# EasyEDA Pro project BLDCv5.eprj, schematic Schematic1
Create Date: 2024-09-21; Page Name: P1; Project Name: BLDCv5; Schematic Name: Schematic1; Update Date: 2024-09-23; Company: EasyEDA.com; Drawn: EasyEDA; Page Size: A4; Part Number: JLCPCB-002; Reviewed: EasyEDA; Version: V0.1
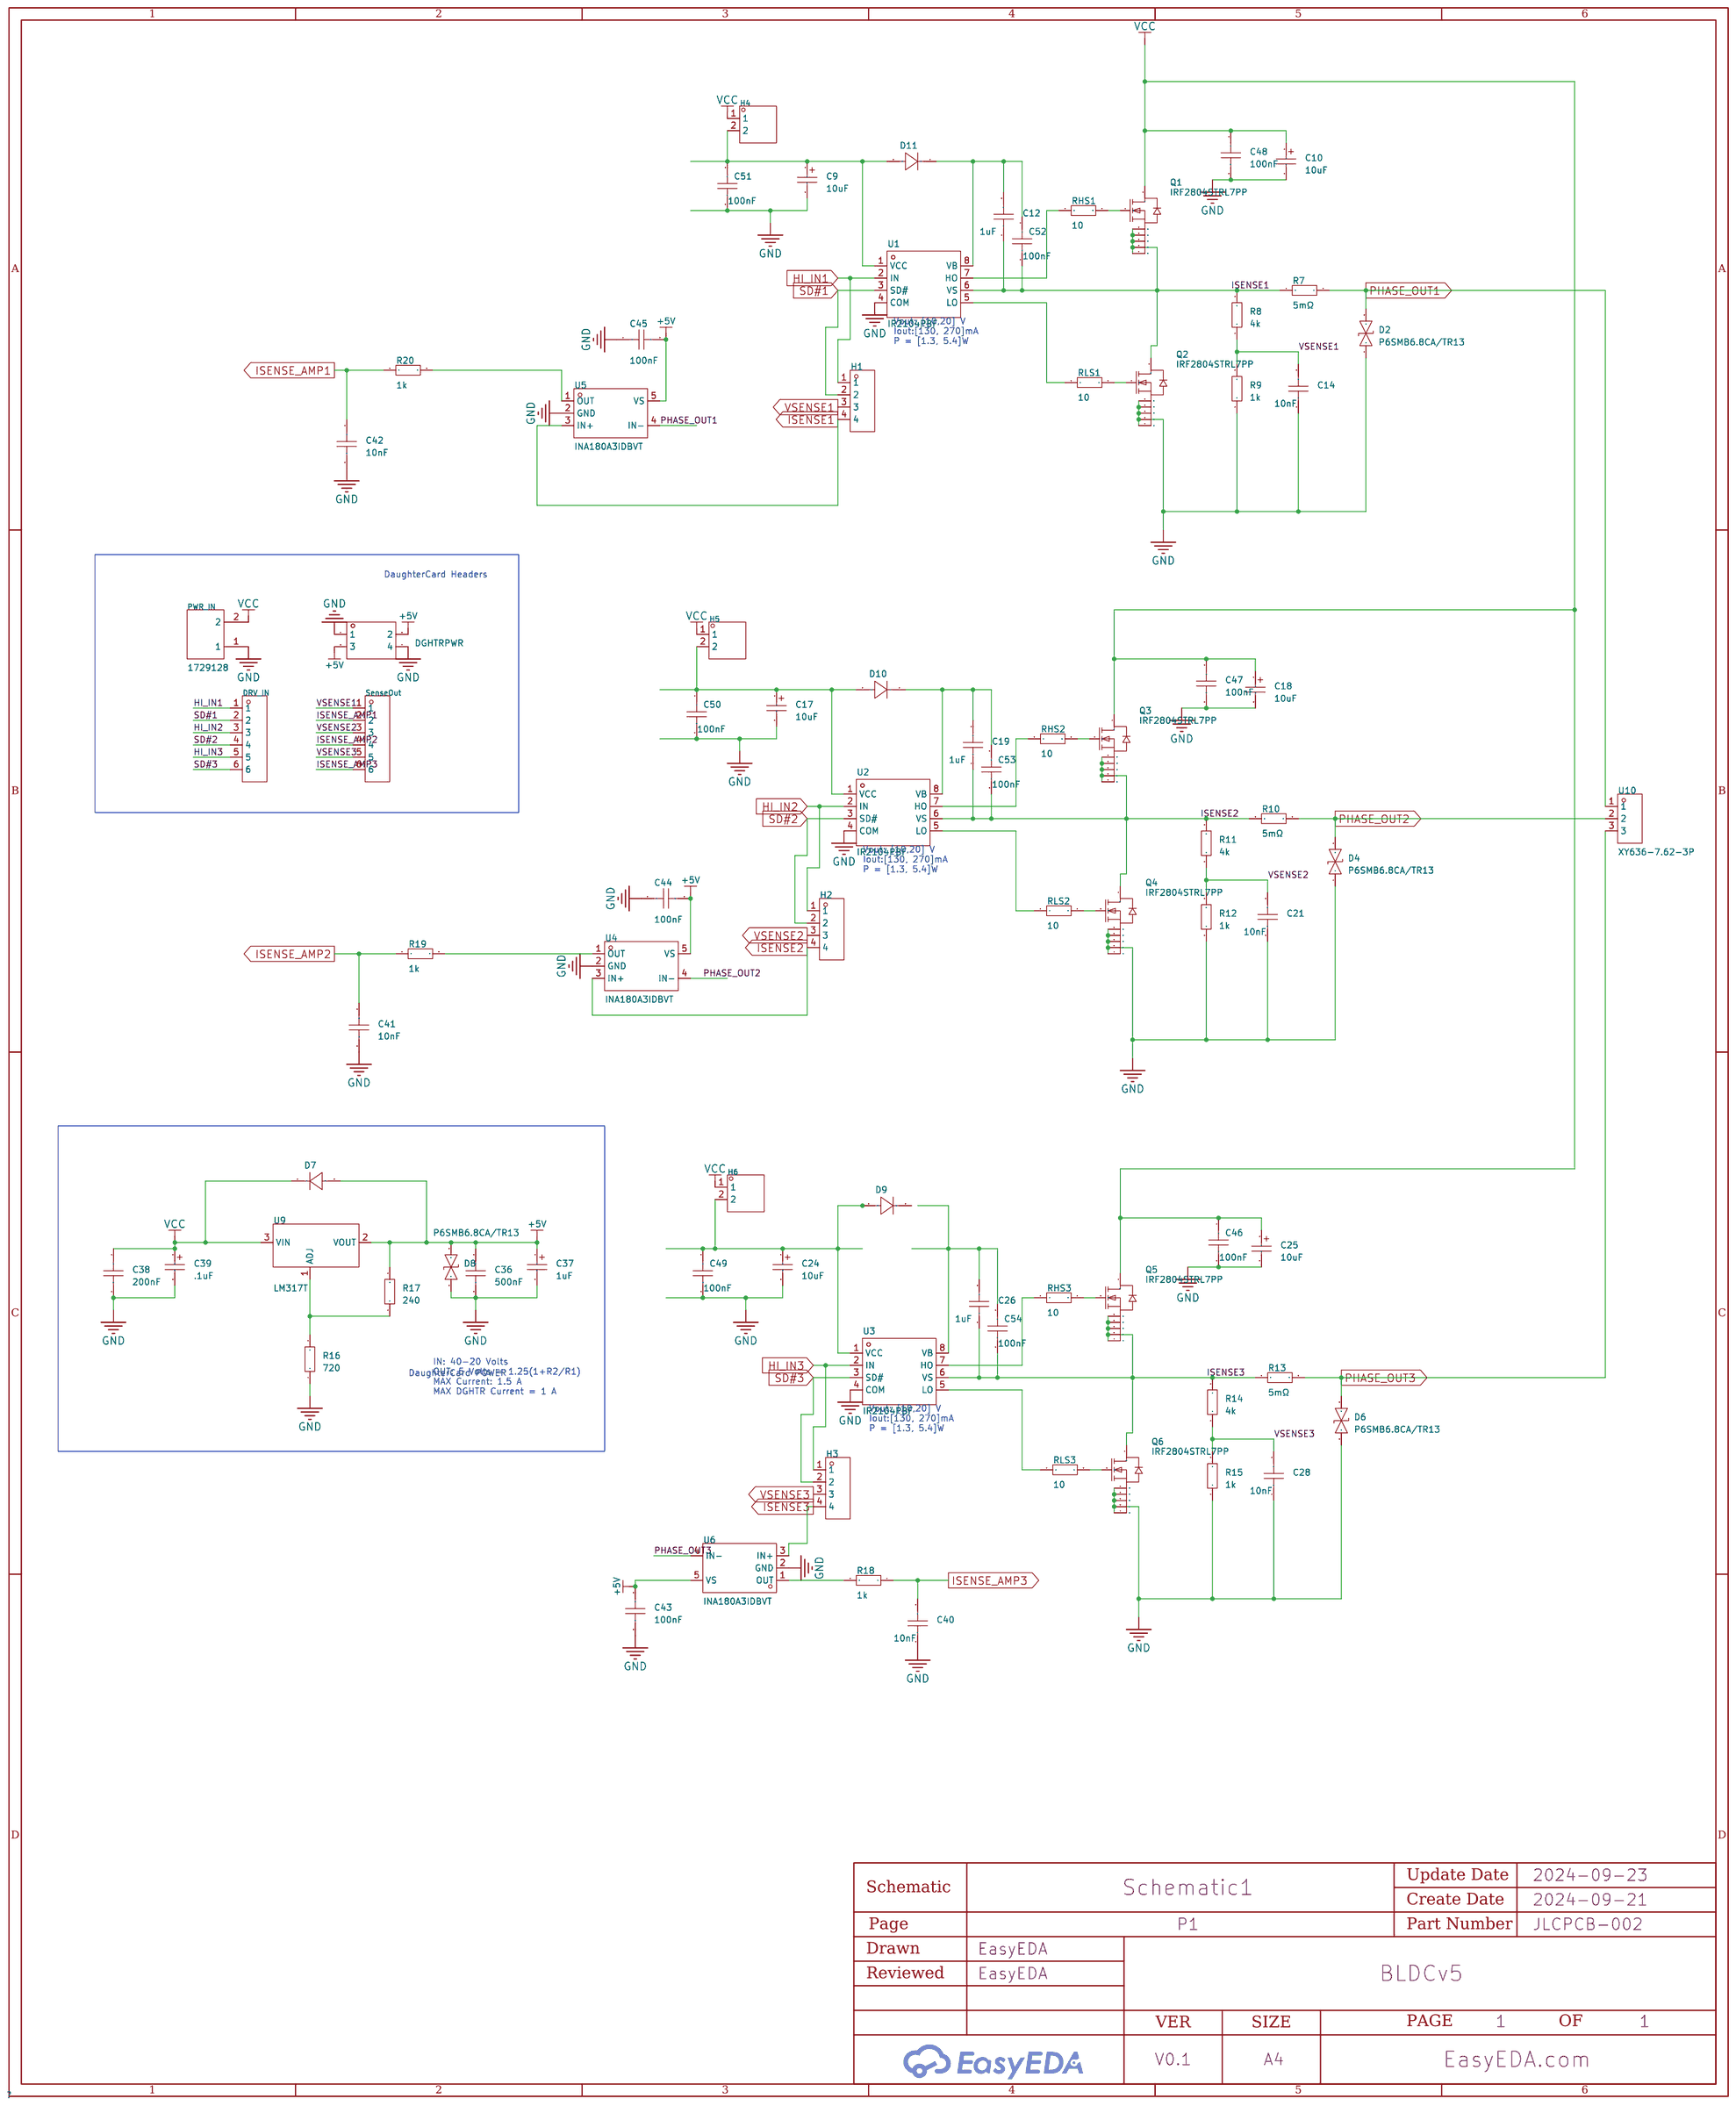
[diagram p0: schematic sheet]

## Parts
C9  10uF  [CAP-SMD_BD5.0-L5.3-W5.3-LS6.3-FD]
C10  10uF  [CAP-SMD_BD5.0-L5.3-W5.3-LS6.3-FD]
C12  1uF  [CAP-TH_L7.2-W2.5-P5.00-D0.6]
C14  10nF  [CAP-TH_L7.2-W2.5-P5.00-D0.6]
C17  10uF  [CAP-SMD_BD5.0-L5.3-W5.3-LS6.3-FD]
C18  10uF  [CAP-SMD_BD5.0-L5.3-W5.3-LS6.3-FD]
C19  1uF  [CAP-TH_L7.2-W2.5-P5.00-D0.6]
C21  10nF  [CAP-TH_L7.2-W2.5-P5.00-D0.6]
C24  10uF  [CAP-SMD_BD5.0-L5.3-W5.3-LS6.3-FD]
C25  10uF  [CAP-SMD_BD5.0-L5.3-W5.3-LS6.3-FD]
C26  1uF  [CAP-TH_L7.2-W2.5-P5.00-D0.6]
C28  10nF  [CAP-TH_L7.2-W2.5-P5.00-D0.6]
C36  500nF  [C0603]
C37  1uF  [CAP-SMD_BD5.0-L5.3-W5.3-LS6.3-FD]
C38  200nF  [C0603]
C39  .1uF  [CAP-SMD_BD5.0-L5.3-W5.3-LS6.3-FD]
C40  10nF  [CAP-TH_L7.2-W2.5-P5.00-D0.6]
C41  10nF  [CAP-TH_L7.2-W2.5-P5.00-D0.6]
C42  10nF  [CAP-TH_L7.2-W2.5-P5.00-D0.6]
C43  100nF  [C0805]
C44  100nF  [C0805]
C45  100nF  [C0805]
C46  100nF  [C0805]
C47  100nF  [C0805]
C48  100nF  [C0805]
C49  100nF  [C0805]
C50  100nF  [C0805]
C51  100nF  [C0805]
C52  100nF  [C0805]
C53  100nF  [C0805]
C54  100nF  [C0805]
D2  P6SMB6.8CA/TR13  [SMB_L4.6-W3.6-LS5.3-BI]
D4  P6SMB6.8CA/TR13  [SMB_L4.6-W3.6-LS5.3-BI]
D6  P6SMB6.8CA/TR13  [SMB_L4.6-W3.6-LS5.3-BI]
D7  -  [DO-41_BD2.4-L4.7-P8.70-D0.9-RD]
D8  P6SMB6.8CA/TR13  [SMB_L4.6-W3.6-LS5.3-BI]
D9  -  [DO-41_BD2.4-L4.7-P8.70-D0.9-RD]
D10  -  [DO-41_BD2.4-L4.7-P8.70-D0.9-RD]
D11  -  [DO-41_BD2.4-L4.7-P8.70-D0.9-RD]
DGHTRPWR  -  [HDR-TH_4P-P2.54-V-F-R2-C2-S2.54]
DRV_IN  -  [HDR-TH_6P-P2.54-V-F]
H1  -  [HDR-TH_4P-P2.54-V-M]
H2  -  [HDR-TH_4P-P2.54-V-M]
H3  -  [HDR-TH_4P-P2.54-V-M]
H4  -  [HDR-TH_2P-P2.54-V-M-1]
H5  -  [HDR-TH_2P-P2.54-V-M-1]
H6  -  [HDR-TH_2P-P2.54-V-M-1]
PWR_IN  1729128  [CONN-TH_2P-P5.08]
Q1  IRF2804STRL7PP  [D2PAK-7_L10.6-W9.6-P1.27-LS15.9-BR]
Q2  IRF2804STRL7PP  [D2PAK-7_L10.6-W9.6-P1.27-LS15.9-BR]
Q3  IRF2804STRL7PP  [D2PAK-7_L10.6-W9.6-P1.27-LS15.9-BR]
Q4  IRF2804STRL7PP  [D2PAK-7_L10.6-W9.6-P1.27-LS15.9-BR]
Q5  IRF2804STRL7PP  [D2PAK-7_L10.6-W9.6-P1.27-LS15.9-BR]
Q6  IRF2804STRL7PP  [D2PAK-7_L10.6-W9.6-P1.27-LS15.9-BR]
R7  5mΩ  [R2512]
R8  4k  [RES-TH_BD3.3-L9.0-P13.00-D0.6]
R9  1k  [RES-TH_BD3.3-L9.0-P13.00-D0.6]
R10  5mΩ  [R2512]
R11  4k  [RES-TH_BD3.3-L9.0-P13.00-D0.6]
R12  1k  [RES-TH_BD3.3-L9.0-P13.00-D0.6]
R13  5mΩ  [R2512]
R14  4k  [RES-TH_BD3.3-L9.0-P13.00-D0.6]
R15  1k  [RES-TH_BD3.3-L9.0-P13.00-D0.6]
R16  720  [RES-TH_BD3.3-L9.0-P13.00-D0.6]
R17  240  [RES-TH_BD3.3-L9.0-P13.00-D0.6]
R18  1k  [RES-TH_BD3.3-L9.0-P13.00-D0.6]
R19  1k  [RES-TH_BD3.3-L9.0-P13.00-D0.6]
R20  1k  [RES-TH_BD3.3-L9.0-P13.00-D0.6]
RHS1  10  [R1210]
RHS2  10  [R1210]
RHS3  10  [R1210]
RLS1  10  [R1210]
RLS2  10  [R1210]
RLS3  10  [R1210]
SenseOut  -  [HDR-TH_6P-P2.54-V-F]
U1  IR2104PBF  [DIP-8_L9.9-W6.6-P2.54-LS7.62-BL]
U2  IR2104PBF  [DIP-8_L9.9-W6.6-P2.54-LS7.62-BL]
U3  IR2104PBF  [DIP-8_L9.9-W6.6-P2.54-LS7.62-BL]
U4  INA180A3IDBVT  [SOT-23-5_L2.9-W1.6-P0.95-LS2.8-TL]
U5  INA180A3IDBVT  [SOT-23-5_L2.9-W1.6-P0.95-LS2.8-TL]
U6  INA180A3IDBVT  [SOT-23-5_L2.9-W1.6-P0.95-LS2.8-TL]
U9  LM317T  [TO-220-3_L10.0-W4.6-P2.54-L]
U10  XY636-7.62-3P  [CONN-TH_XY636-7.62-3P]

## Library data of the parts
C9 C10 C17 C18 C24 C25 C37 C39 = C_Ele_SMD_5x5.4mm: Supplier Footprint: SMD,5x5.4mm
C12 C14 C19 C21 C26 C28 C40-C42 = SMEC334J100M2: Capacitance: Tolerance:±5% Tolerance:±5% Voltage Rated:; LCSC Part Name: 330nF ±5% 100V; Supplier Part: C401104; Manufacturer: CHAMPION(全鹏); Supplier Footprint: 插件,P=5mm; JLCPCB Part Class: Extended Part; Datasheet: https://atta.szlcsc.com/upload/public/pdf/source/20190730/C401104_3330673C3D333BC9993FC47731C2A492.pdf; Supplier: LCSC; Tolerance: ±5%
C36 C38 = CAP_0603: Supplier Footprint: 0603
C43-C54 = CAP_0805: Supplier Footprint: 0805
D2 D4 D6 D8 = P6SMB6.8CA/TR13: Reverse Stand-Off Voltage (Vrwm):5.8V Maximum Clamping Voltage:10.5V Peak Pulse Current (Ipp)@10/1000us:58.1A Peak Pulse Power Dissipation (Ppp)@10/1000us:600W Breakdown Voltage:6.45V Type:TVS; Supplier Part: C78395; Manufacturer: Brightking(君耀电子); Supplier Footprint: SMB(DO-214AA); JLCPCB Part Class: Basic Part; Datasheet: https://atta.szlcsc.com/upload/public/pdf/source/20160709/1468031879762.pdf; Supplier: LCSC; Reverse Stand-Off Voltage (Vrwm): 5.8V; Maximum Clamping Voltage: 10.5V; Peak Pulse Current (Ipp)@10/1000us: 58.1A; Peak Pulse Power Dissipation (Ppp)@10/1000us: 600W; Breakdown Voltage: 6.45V; Type: TVS
D7 D9-D11 = 1N4007: Supplier Footprint: DO-41
DGHTRPWR = HDR-F-2.54_2x2: Supplier Footprint: Through
DRV_IN SenseOut = HDR-F_2.54_1x6P: Supplier Footprint: Through
H1-H3 = HDR-M_2.54_1x4P: Supplier Footprint: Through
H4-H6 = HDR-M_2.54_1x2P: Supplier Footprint: Through
PWR_IN = 1729128: Structure:1x2P Pitch:5.08mm Color:Green Mounting Style:Straight Current Rating (Max):13.5A Voltage Rating (Max):400V Number of Pins:2P Number of Rows:1 Wire Gauge - AWG:14~30 Wire Gauge - AWG:14~30 Number of PINs Per Row:2 Operating Temperature Range:- Op; LCSC Part Name: 停产; Supplier Part: C91153; Manufacturer: Phoenix Contact(菲尼克斯); Supplier Footprint: 插件,P=5.08mm; JLCPCB Part Class: Extended Part; Datasheet: https://atta.szlcsc.com/upload/public/pdf/source/20161226/1482720163948.pdf; Supplier: LCSC; Structure: 1x2P; Pitch: 5.08mm; Color: Green; Mounting Style: Straight; Current Rating (Max): 13.5A; Voltage Rating (Max): 400V; Number of Pins: 2P; Number of Rows: 1; Wire Gauge - AWG: 14~30; Number of PINs Per Row: 2
Q1-Q6 = IRF2804STRL7PP: Supplier Part: C459950; Manufacturer: Infineon(英飞凌); Supplier Footprint: TO-252-3; JLCPCB Part Class: Extended Part; Datasheet: https://atta.szlcsc.com/upload/public/pdf/source/20211220/39CD65D483719D465F1A88FFAD2C5DF5.pdf; Supplier: LCSC
R7 R10 R13 = PA2512FKF7W0R005E: Type:Current Sensing Resistors Resistance: Tolerance:±1% Tolerance:±1% Power(Watts): Temperature Coefficient:±100ppm/℃ Temperature Coefficient:±100ppm/℃; LCSC Part Name: 5mΩ ±1% 2W; Supplier Part: C309526; Manufacturer: YAGEO(国巨); Supplier Footprint: 2512; JLCPCB Part Class: Extended Part; Datasheet: https://atta.szlcsc.com/upload/public/pdf/source/20190227/C375693_219964CC8B3EBD36DBDF701587FA5938.pdf; Supplier: LCSC; Type: Current Sensing Resistors; Tolerance: ±1%; Temperature Coefficient: ±100ppm/℃
R8 R9 R11 R12 R14-R20 = Res_AXIAL-1/2W: Supplier Footprint: Through
RHS1-RHS3 RLS1-RLS3 = Res_1210: Supplier Footprint: 1210
U1-U3 = IR2104PBF: Driven Configuration:Half Bridge Load Type:MOSFET；IGBT Number of Drivers:2 Peak Output Current(sink):360mA Peak Output Current(source):210mA Supply Voltage:10V~20V Supply Voltage:10V~20V Rise Time:100ns Fall Time:50ns Operating Temperature:-40℃~+150℃@(Tj); LCSC Part Name: IR2104PBF 停产; Supplier Part: C2959; Manufacturer: Infineon(英飞凌); Supplier Footprint: PDIP-8; JLCPCB Part Class: Extended Part; Datasheet: https://atta.szlcsc.com/upload/public/pdf/source/20140906/1457707236579.pdf; Supplier: LCSC; Driven Configuration: Half Bridge; Load Type: MOSFET；IGBT; Number of Drivers: 2; Peak Output Current(sink): 360mA; Peak Output Current(source): 210mA; Supply Voltage: 10V~20V; Rise Time: 100ns; Fall Time: 50ns; Operating Temperature: -40℃~+150℃@(Tj)
U4-U6 = INA180A3IDBVT: Number of Channels:单路 Supply Current:260uA Operating Temperature:-40℃~+125℃ Operating Temperature:-40℃~+125℃; Supplier Part: C2877844; Manufacturer: TI(德州仪器); Supplier Footprint: SOT-23-5; JLCPCB Part Class: Extended Part; Datasheet: https://www.ti.com/cn/lit/gpn/ina180; Supplier: LCSC; Number of Channels: 单路; Supply Current: 260uA; Operating Temperature: -40℃~+125℃
U9 = LM317T_C5444279: Output Type:可调 Maximum Input Voltage:40V Output Voltage:1.7V~37V Output Voltage:1.7V~37V MAX Output Current:1.5A Output Polarity:Positive electrode Number of Outputs:1; Supplier Part: C5444279; Manufacturer: Siproin(上海矽朋); Supplier Footprint: TO-220; JLCPCB Part Class: Extended Part; Datasheet: https://atta.szlcsc.com/upload/public/pdf/source/20230412/703E44E72FEA4765420A69E1CD3AD9D7.pdf; Supplier: LCSC; Output Type: 可调; Maximum Input Voltage: 40V; Output Voltage: 1.7V~37V; MAX Output Current: 1.5A; Output Polarity: Positive electrode; Number of Outputs: 1
U10 = XY636-7.62-3P: Structure:1x3P Pitch:7.62mm Color:Green Mounting Style:Straight Current Rating (Max):30A Voltage Rating (Max):300V Number of Pins:3P Number of Rows:1 Wire Gauge - AWG:10~26 Wire Gauge - AWG:10~26 Wire Gauge - mm2:4 Wire Gauge - mm2:4 Number of PINs Per Ro; LCSC Part Name: 1x3P 7.62mm 直插 排数:1 每排P数:3; Supplier Part: C880593; Manufacturer: XINLAIYA(新莱亚); Supplier Footprint: 插件,P=7.62mm; JLCPCB Part Class: Extended Part; Datasheet: https://atta.szlcsc.com/upload/public/pdf/source/20201013/C880593_D39E4D9453281D8A65D8CBDFFFF89DB3.pdf; Supplier: LCSC; Structure: 1x3P; Pitch: 7.62mm; Color: Green; Mounting Style: Straight; Current Rating (Max): 30A; Voltage Rating (Max): 300V; Number of Pins: 3P; Number of Rows: 1; Wire Gauge - AWG: 10~26; Wire Gauge - mm2: 4; Number of PINs Per Row: 3; Contact Material: Copper; Contact Plating: Tin; Screw Specification: M3

## Nets
+5V: C36.1 C37.1 C43.1 C44.2 C45.2 D7.2(A) D8.2 DGHTRPWR.2 DGHTRPWR.3 R17.2 U4.5(VS) U5.5(VS) U6.5(VS) U9.2(VOUT)
GND: C9.2 C10.2 C14.1 C17.2 C18.2 C21.1 C24.2 C25.2 C28.1 C36.2 C37.2 C38.2 C39.2 C40.1 C41.2 C42.2 C43.2 C44.1 C45.1 C46.2 C47.2 C48.2 C49.2 C50.2 C51.2 D2.1 D4.1 D6.1 D8.1 DGHTRPWR.1 DGHTRPWR.4 PWR_IN.1 Q2.2(S) Q2.3(S) Q2.5(S) Q2.6(S) Q2.7(S) Q4.2(S) Q4.3(S) Q4.5(S) Q4.6(S) Q4.7(S) Q6.2(S) Q6.3(S) Q6.5(S) Q6.6(S) Q6.7(S) R9.1 R12.1 R15.1 R16.1 U1.4(COM) U2.4(COM) U3.4(COM) U4.2(GND) U5.2(GND) U6.2(GND)
VCC: C10.1 C18.1 C25.1 C38.1 C39.1 C46.1 C47.1 C48.1 D7.1(K) H4.1 H5.1 H6.1 PWR_IN.2 Q1.4(D) Q3.4(D) Q5.4(D) U9.3(VIN)
HI_IN1: DRV_IN.1 H1.1 U1.2(IN)
HI_IN2: DRV_IN.3 H2.1 U2.2(IN)
HI_IN3: DRV_IN.5 H3.1 U3.2(IN)
ISENSE1: C12.1 C52.2 H1.4 Q1.2(S) Q1.3(S) Q1.5(S) Q1.6(S) Q1.7(S) Q2.4(D) R7.1 R8.2 U1.6(VS) U5.3(IN+)
ISENSE2: C19.1 C53.2 H2.4 Q3.2(S) Q3.3(S) Q3.5(S) Q3.6(S) Q3.7(S) Q4.4(D) R10.1 R11.2 U2.6(VS) U4.3(IN+)
ISENSE3: C26.1 C54.2 H3.4 Q5.2(S) Q5.3(S) Q5.5(S) Q5.6(S) Q5.7(S) Q6.4(D) R13.1 R14.2 U3.6(VS) U6.3(IN+)
ISENSE_AMP1: C42.1 R20.1 SenseOut.2
ISENSE_AMP2: C41.1 R19.1 SenseOut.4
ISENSE_AMP3: C40.2 R18.1 SenseOut.6
PHASE_OUT1: D2.2 R7.2 U5.4(IN-) U10.1
PHASE_OUT2: D4.2 R10.2 U4.4(IN-) U10.2
PHASE_OUT3: D6.2 R13.2 U6.4(IN-) U10.3
SD#1: DRV_IN.2 H1.2 U1.3(SD#)
SD#2: DRV_IN.4 H2.2 U2.3(SD#)
SD#3: DRV_IN.6 H3.2 U3.3(SD#)
VSENSE1: C14.2 H1.3 R8.1 R9.2 SenseOut.1
VSENSE2: C21.2 H2.3 R11.1 R12.2 SenseOut.3
VSENSE3: C28.2 H3.3 R14.1 R15.2 SenseOut.5
$1N695: RHS1.1 U1.7(HO)
$1N696: Q1.1(G) RHS1.2
$1N697: RLS1.1 U1.5(LO)
$1N698: Q2.1(G) RLS1.2
$1N719: C12.2 C52.1 D11.1(K) U1.8(VB)
$1N1386: RHS2.1 U2.7(HO)
$1N1387: Q3.1(G) RHS2.2
$1N1388: RLS2.1 U2.5(LO)
$1N1389: Q4.1(G) RLS2.2
$1N1402: C17.1 C50.1 D10.2(A) H5.2 U2.1(VCC)
$1N1410: C19.2 C53.1 D10.1(K) U2.8(VB)
$1N2077: RHS3.1 U3.7(HO)
$1N2078: Q5.1(G) RHS3.2
$1N2079: RLS3.1 U3.5(LO)
$1N2080: Q6.1(G) RLS3.2
$1N11632: R16.2 R17.1 U9.1(ADJ)
$1N15082: R19.2 U4.1(OUT)
$1N15123: R18.2 U6.1(OUT)
$1N19803: R20.2 U5.1(OUT)
$1N19890: C9.1 C51.1 D11.2(A) H4.2 U1.1(VCC)
$1N23718: C24.1 C49.1 D9.2(A) H6.2 U3.1(VCC)
Net-(C26-2): C26.2 C54.1 U3.8(VB)

Not connected (* = marked no-connect by the designer): D9 1(K)

## Notes on the sheet
- Vout: [10,20] V
  Iout:[130, 270]mA
  P = [1.3, 5.4]W
- DaughterCard Headers
- Vout: [10,20] V
  Iout:[130, 270]mA
  P = [1.3, 5.4]W
- DaughterCard POWER
- IN: 40-20 Volts
  OUT: 5 Volts = 1.25(1+R2/R1)
  MAX Current: 1.5 A
  MAX DGHTR Current = 1 A
- Vout: [10,20] V
  Iout:[130, 270]mA
  P = [1.3, 5.4]W
